# EAGLE board Resistor_Resistor (EAGLE 8.3.0), part 26 of 32
## Placement (x,y rotation side) (continued)
R31697  10K  [0201]  217.98,59.79 0 top
R31698  10K  [0201]  217.98,60.4 0 top
R31699  10K  [0201]  217.98,61.01 0 top
R31700  10K  [0201]  217.98,61.62 0 top
R31701  10K  [0201]  217.98,62.23 0 top
R31702  10K  [0201]  217.98,62.84 0 top
R31703  10K  [0201]  217.98,63.45 0 top
R31704  10K  [0201]  217.98,64.06 0 top
R31705  10K  [0201]  217.98,64.67 0 top
R31706  10K  [0201]  217.98,65.28 0 top
R31707  10K  [0201]  217.98,65.89 0 top
R31708  10K  [0201]  217.98,66.5 0 top
R31709  10K  [0201]  217.98,67.11 0 top
R31710  10K  [0201]  217.98,67.72 0 top
R31711  10K  [0201]  217.98,68.33 0 top
R31712  10K  [0201]  217.98,68.94 0 top
R31713  10K  [0201]  217.98,69.55 0 top
R31714  10K  [0201]  217.98,70.15 0 top
R31715  10K  [0201]  217.98,70.76 0 top
R31716  10K  [0201]  217.98,71.37 0 top
R31717  10K  [0201]  217.98,71.98 0 top
R31718  10K  [0201]  217.98,72.59 0 top
R31719  10K  [0201]  217.98,73.2 0 top
R31720  10K  [0201]  217.98,73.81 0 top
R31721  10K  [0201]  217.98,74.42 0 top
R31722  10K  [0201]  217.98,75.03 0 top
R31723  10K  [0201]  217.98,75.64 0 top
R31724  10K  [0201]  217.98,76.25 0 top
R31725  10K  [0201]  217.98,76.86 0 top
R31726  10K  [0201]  217.98,77.47 0 top
R31727  10K  [0201]  217.98,78.08 0 top
R31728  10K  [0201]  217.98,78.69 0 top
R31729  10K  [0201]  217.98,79.3 0 top
R31730  10K  [0201]  217.98,79.91 0 top
R31731  10K  [0201]  217.98,80.52 0 top
R31732  10K  [0201]  217.98,81.13 0 top
R31733  10K  [0201]  217.98,81.74 0 top
R31734  10K  [0201]  217.98,82.35 0 top
R31735  10K  [0201]  217.98,82.96 0 top
R31736  10K  [0201]  217.98,83.57 0 top
R31737  10K  [0201]  217.98,84.18 0 top
R31738  10K  [0201]  217.98,84.79 0 top
R31739  10K  [0201]  217.98,85.39 0 top
R31740  10K  [0201]  217.98,86 0 top
R31741  10K  [0201]  217.98,86.61 0 top
R31742  10K  [0201]  217.98,87.22 0 top
R31743  10K  [0201]  217.98,87.83 0 top
R31744  10K  [0201]  217.98,88.44 0 top
R31745  10K  [0201]  217.98,89.05 0 top
R31746  10K  [0201]  217.98,89.66 0 top
R31747  10K  [0201]  217.98,90.27 0 top
R31748  10K  [0201]  217.98,90.88 0 top
R31749  10K  [0201]  217.98,91.49 0 top
R31750  10K  [0201]  217.98,92.1 0 top
R31751  10K  [0201]  217.98,92.71 0 top
R31752  10K  [0201]  217.98,93.32 0 top
R31753  10K  [0201]  217.98,93.93 0 top
R31754  10K  [0201]  217.98,94.54 0 top
R31755  10K  [0201]  217.98,95.15 0 top
R31756  10K  [0201]  217.98,95.76 0 top
R31757  10K  [0201]  217.98,96.37 0 top
R31758  10K  [0201]  217.98,96.98 0 top
R31759  10K  [0201]  217.98,97.59 0 top
R31760  10K  [0201]  217.98,98.2 0 top
R31761  10K  [0201]  217.98,98.81 0 top
R31762  10K  [0201]  217.98,99.42 0 top
R31763  10K  [0201]  217.98,100.03 0 top
R31764  10K  [0201]  217.98,100.63 0 top
R31765  10K  [0201]  217.98,101.24 0 top
R31766  10K  [0201]  217.98,101.85 0 top
R31767  10K  [0201]  217.98,102.46 0 top
R31768  10K  [0201]  217.98,103.07 0 top
R31769  10K  [0201]  217.98,103.68 0 top
R31770  10K  [0201]  217.98,104.29 0 top
R31771  10K  [0201]  217.98,104.9 0 top
R31772  10K  [0201]  217.98,105.51 0 top
R31773  10K  [0201]  217.98,106.12 0 top
R31774  10K  [0201]  217.98,106.73 0 top
R31775  10K  [0201]  217.98,107.34 0 top
R31776  10K  [0201]  217.98,107.95 0 top
R31777  10K  [0201]  217.98,108.56 0 top
R31778  10K  [0201]  217.98,109.17 0 top
R31779  10K  [0201]  217.98,109.78 0 top
R31780  10K  [0201]  217.98,110.39 0 top
R31781  10K  [0201]  217.98,111 0 top
R31782  10K  [0201]  217.98,111.61 0 top
R31783  10K  [0201]  217.98,112.22 0 top
R31784  10K  [0201]  217.98,112.83 0 top
R31785  10K  [0201]  217.98,113.44 0 top
R31786  10K  [0201]  217.98,114.05 0 top
R31787  10K  [0201]  217.98,114.66 0 top
R31788  10K  [0201]  217.98,115.27 0 top
R31789  10K  [0201]  217.98,115.87 0 top
R31790  10K  [0201]  217.98,116.48 0 top
R31791  10K  [0201]  217.98,117.09 0 top
R31792  10K  [0201]  217.98,117.7 0 top
R31793  10K  [0201]  217.98,118.31 0 top
R31794  10K  [0201]  217.98,118.92 0 top
R31795  10K  [0201]  217.98,119.53 0 top
R31796  10K  [0201]  217.98,120.14 0 top
R31797  10K  [0201]  217.98,120.75 0 top
R31798  10K  [0201]  217.98,121.36 0 top
R31799  10K  [0201]  217.98,121.97 0 top
R31800  10K  [0201]  217.98,122.58 0 top
R31801  10K  [0201]  219.2,1.27 0 top
R31802  10K  [0201]  219.2,1.88 0 top
R31803  10K  [0201]  219.2,2.49 0 top
R31804  10K  [0201]  219.2,3.1 0 top
R31805  10K  [0201]  219.2,3.71 0 top
R31806  10K  [0201]  219.2,4.32 0 top
R31807  10K  [0201]  219.2,4.93 0 top
R31808  10K  [0201]  219.2,5.54 0 top
R31809  10K  [0201]  219.2,6.15 0 top
R31810  10K  [0201]  219.2,6.76 0 top
R31811  10K  [0201]  219.2,7.37 0 top
R31812  10K  [0201]  219.2,7.98 0 top
R31813  10K  [0201]  219.2,8.59 0 top
R31814  10K  [0201]  219.2,9.19 0 top
R31815  10K  [0201]  219.2,9.8 0 top
R31816  10K  [0201]  219.2,10.41 0 top
R31817  10K  [0201]  219.2,11.02 0 top
R31818  10K  [0201]  219.2,11.63 0 top
R31819  10K  [0201]  219.2,12.24 0 top
R31820  10K  [0201]  219.2,12.85 0 top
R31821  10K  [0201]  219.2,13.46 0 top
R31822  10K  [0201]  219.2,14.07 0 top
R31823  10K  [0201]  219.2,14.68 0 top
R31824  10K  [0201]  219.2,15.29 0 top
R31825  10K  [0201]  219.2,15.9 0 top
R31826  10K  [0201]  219.2,16.51 0 top
R31827  10K  [0201]  219.2,17.12 0 top
R31828  10K  [0201]  219.2,17.73 0 top
R31829  10K  [0201]  219.2,18.34 0 top
R31830  10K  [0201]  219.2,18.95 0 top
R31831  10K  [0201]  219.2,19.56 0 top
R31832  10K  [0201]  219.2,20.17 0 top
R31833  10K  [0201]  219.2,20.78 0 top
R31834  10K  [0201]  219.2,21.39 0 top
R31835  10K  [0201]  219.2,22 0 top
R31836  10K  [0201]  219.2,22.61 0 top
R31837  10K  [0201]  219.2,23.22 0 top
R31838  10K  [0201]  219.2,23.83 0 top
R31839  10K  [0201]  219.2,24.43 0 top
R31840  10K  [0201]  219.2,25.04 0 top
R31841  10K  [0201]  219.2,25.65 0 top
R31842  10K  [0201]  219.2,26.26 0 top
R31843  10K  [0201]  219.2,26.87 0 top
R31844  10K  [0201]  219.2,27.48 0 top
R31845  10K  [0201]  219.2,28.09 0 top
R31846  10K  [0201]  219.2,28.7 0 top
R31847  10K  [0201]  219.2,29.31 0 top
R31848  10K  [0201]  219.2,29.92 0 top
R31849  10K  [0201]  219.2,30.53 0 top
R31850  10K  [0201]  219.2,31.14 0 top
R31851  10K  [0201]  219.2,31.75 0 top
R31852  10K  [0201]  219.2,32.36 0 top
R31853  10K  [0201]  219.2,32.97 0 top
R31854  10K  [0201]  219.2,33.58 0 top
R31855  10K  [0201]  219.2,34.19 0 top
R31856  10K  [0201]  219.2,34.8 0 top
R31857  10K  [0201]  219.2,35.41 0 top
R31858  10K  [0201]  219.2,36.02 0 top
R31859  10K  [0201]  219.2,36.63 0 top
R31860  10K  [0201]  219.2,37.24 0 top
R31861  10K  [0201]  219.2,37.85 0 top
R31862  10K  [0201]  219.2,38.46 0 top
R31863  10K  [0201]  219.2,39.07 0 top
R31864  10K  [0201]  219.2,39.67 0 top
R31865  10K  [0201]  219.2,40.28 0 top
R31866  10K  [0201]  219.2,40.89 0 top
R31867  10K  [0201]  219.2,41.5 0 top
R31868  10K  [0201]  219.2,42.11 0 top
R31869  10K  [0201]  219.2,42.72 0 top
R31870  10K  [0201]  219.2,43.33 0 top
R31871  10K  [0201]  219.2,43.94 0 top
R31872  10K  [0201]  219.2,44.55 0 top
R31873  10K  [0201]  219.2,45.16 0 top
R31874  10K  [0201]  219.2,45.77 0 top
R31875  10K  [0201]  219.2,46.38 0 top
R31876  10K  [0201]  219.2,46.99 0 top
R31877  10K  [0201]  219.2,47.6 0 top
R31878  10K  [0201]  219.2,48.21 0 top
R31879  10K  [0201]  219.2,48.82 0 top
R31880  10K  [0201]  219.2,49.43 0 top
R31881  10K  [0201]  219.2,50.04 0 top
R31882  10K  [0201]  219.2,50.65 0 top
R31883  10K  [0201]  219.2,51.26 0 top
R31884  10K  [0201]  219.2,51.87 0 top
R31885  10K  [0201]  219.2,52.48 0 top
R31886  10K  [0201]  219.2,53.09 0 top
R31887  10K  [0201]  219.2,53.7 0 top
R31888  10K  [0201]  219.2,54.31 0 top
R31889  10K  [0201]  219.2,54.91 0 top
R31890  10K  [0201]  219.2,55.52 0 top
R31891  10K  [0201]  219.2,56.13 0 top
R31892  10K  [0201]  219.2,56.74 0 top
R31893  10K  [0201]  219.2,57.35 0 top
R31894  10K  [0201]  219.2,57.96 0 top
R31895  10K  [0201]  219.2,58.57 0 top
R31896  10K  [0201]  219.2,59.18 0 top
R31897  10K  [0201]  219.2,59.79 0 top
R31898  10K  [0201]  219.2,60.4 0 top
R31899  10K  [0201]  219.2,61.01 0 top
R31900  10K  [0201]  219.2,61.62 0 top
R31901  10K  [0201]  219.2,62.23 0 top
R31902  10K  [0201]  219.2,62.84 0 top
R31903  10K  [0201]  219.2,63.45 0 top
R31904  10K  [0201]  219.2,64.06 0 top
R31905  10K  [0201]  219.2,64.67 0 top
R31906  10K  [0201]  219.2,65.28 0 top
R31907  10K  [0201]  219.2,65.89 0 top
R31908  10K  [0201]  219.2,66.5 0 top
R31909  10K  [0201]  219.2,67.11 0 top
R31910  10K  [0201]  219.2,67.72 0 top
R31911  10K  [0201]  219.2,68.33 0 top
R31912  10K  [0201]  219.2,68.94 0 top
R31913  10K  [0201]  219.2,69.55 0 top
R31914  10K  [0201]  219.2,70.15 0 top
R31915  10K  [0201]  219.2,70.76 0 top
R31916  10K  [0201]  219.2,71.37 0 top
R31917  10K  [0201]  219.2,71.98 0 top
R31918  10K  [0201]  219.2,72.59 0 top
R31919  10K  [0201]  219.2,73.2 0 top
R31920  10K  [0201]  219.2,73.81 0 top
R31921  10K  [0201]  219.2,74.42 0 top
R31922  10K  [0201]  219.2,75.03 0 top
R31923  10K  [0201]  219.2,75.64 0 top
R31924  10K  [0201]  219.2,76.25 0 top
R31925  10K  [0201]  219.2,76.86 0 top
R31926  10K  [0201]  219.2,77.47 0 top
R31927  10K  [0201]  219.2,78.08 0 top
R31928  10K  [0201]  219.2,78.69 0 top
R31929  10K  [0201]  219.2,79.3 0 top
R31930  10K  [0201]  219.2,79.91 0 top
R31931  10K  [0201]  219.2,80.52 0 top
R31932  10K  [0201]  219.2,81.13 0 top
R31933  10K  [0201]  219.2,81.74 0 top
R31934  10K  [0201]  219.2,82.35 0 top
R31935  10K  [0201]  219.2,82.96 0 top
R31936  10K  [0201]  219.2,83.57 0 top
R31937  10K  [0201]  219.2,84.18 0 top
R31938  10K  [0201]  219.2,84.79 0 top
R31939  10K  [0201]  219.2,85.39 0 top
R31940  10K  [0201]  219.2,86 0 top
R31941  10K  [0201]  219.2,86.61 0 top
R31942  10K  [0201]  219.2,87.22 0 top
R31943  10K  [0201]  219.2,87.83 0 top
R31944  10K  [0201]  219.2,88.44 0 top
R31945  10K  [0201]  219.2,89.05 0 top
R31946  10K  [0201]  219.2,89.66 0 top
R31947  10K  [0201]  219.2,90.27 0 top
R31948  10K  [0201]  219.2,90.88 0 top
R31949  10K  [0201]  219.2,91.49 0 top
R31950  10K  [0201]  219.2,92.1 0 top
R31951  10K  [0201]  219.2,92.71 0 top
R31952  10K  [0201]  219.2,93.32 0 top
R31953  10K  [0201]  219.2,93.93 0 top
R31954  10K  [0201]  219.2,94.54 0 top
R31955  10K  [0201]  219.2,95.15 0 top
R31956  10K  [0201]  219.2,95.76 0 top
R31957  10K  [0201]  219.2,96.37 0 top
R31958  10K  [0201]  219.2,96.98 0 top
R31959  10K  [0201]  219.2,97.59 0 top
R31960  10K  [0201]  219.2,98.2 0 top
R31961  10K  [0201]  219.2,98.81 0 top
R31962  10K  [0201]  219.2,99.42 0 top
R31963  10K  [0201]  219.2,100.03 0 top
R31964  10K  [0201]  219.2,100.63 0 top
R31965  10K  [0201]  219.2,101.24 0 top
R31966  10K  [0201]  219.2,101.85 0 top
R31967  10K  [0201]  219.2,102.46 0 top
R31968  10K  [0201]  219.2,103.07 0 top
R31969  10K  [0201]  219.2,103.68 0 top
R31970  10K  [0201]  219.2,104.29 0 top
R31971  10K  [0201]  219.2,104.9 0 top
R31972  10K  [0201]  219.2,105.51 0 top
R31973  10K  [0201]  219.2,106.12 0 top
R31974  10K  [0201]  219.2,106.73 0 top
R31975  10K  [0201]  219.2,107.34 0 top
R31976  10K  [0201]  219.2,107.95 0 top
R31977  10K  [0201]  219.2,108.56 0 top
R31978  10K  [0201]  219.2,109.17 0 top
R31979  10K  [0201]  219.2,109.78 0 top
R31980  10K  [0201]  219.2,110.39 0 top
R31981  10K  [0201]  219.2,111 0 top
R31982  10K  [0201]  219.2,111.61 0 top
R31983  10K  [0201]  219.2,112.22 0 top
R31984  10K  [0201]  219.2,112.83 0 top
R31985  10K  [0201]  219.2,113.44 0 top
R31986  10K  [0201]  219.2,114.05 0 top
R31987  10K  [0201]  219.2,114.66 0 top
R31988  10K  [0201]  219.2,115.27 0 top
R31989  10K  [0201]  219.2,115.87 0 top
R31990  10K  [0201]  219.2,116.48 0 top
R31991  10K  [0201]  219.2,117.09 0 top
R31992  10K  [0201]  219.2,117.7 0 top
R31993  10K  [0201]  219.2,118.31 0 top
R31994  10K  [0201]  219.2,118.92 0 top
R31995  10K  [0201]  219.2,119.53 0 top
R31996  10K  [0201]  219.2,120.14 0 top
R31997  10K  [0201]  219.2,120.75 0 top
R31998  10K  [0201]  219.2,121.36 0 top
R31999  10K  [0201]  219.2,121.97 0 top
R32000  10K  [0201]  219.2,122.58 0 top
R32001  10K  [0201]  220.42,1.27 0 top
R32002  10K  [0201]  220.42,1.88 0 top
R32003  10K  [0201]  220.42,2.49 0 top
R32004  10K  [0201]  220.42,3.1 0 top
R32005  10K  [0201]  220.42,3.71 0 top
R32006  10K  [0201]  220.42,4.32 0 top
R32007  10K  [0201]  220.42,4.93 0 top
R32008  10K  [0201]  220.42,5.54 0 top
R32009  10K  [0201]  220.42,6.15 0 top
R32010  10K  [0201]  220.42,6.76 0 top
R32011  10K  [0201]  220.42,7.37 0 top
R32012  10K  [0201]  220.42,7.98 0 top
R32013  10K  [0201]  220.42,8.59 0 top
R32014  10K  [0201]  220.42,9.19 0 top
R32015  10K  [0201]  220.42,9.8 0 top
R32016  10K  [0201]  220.42,10.41 0 top
R32017  10K  [0201]  220.42,11.02 0 top
R32018  10K  [0201]  220.42,11.63 0 top
R32019  10K  [0201]  220.42,12.24 0 top
R32020  10K  [0201]  220.42,12.85 0 top
R32021  10K  [0201]  220.42,13.46 0 top
R32022  10K  [0201]  220.42,14.07 0 top
R32023  10K  [0201]  220.42,14.68 0 top
R32024  10K  [0201]  220.42,15.29 0 top
R32025  10K  [0201]  220.42,15.9 0 top
R32026  10K  [0201]  220.42,16.51 0 top
R32027  10K  [0201]  220.42,17.12 0 top
R32028  10K  [0201]  220.42,17.73 0 top
R32029  10K  [0201]  220.42,18.34 0 top
R32030  10K  [0201]  220.42,18.95 0 top
R32031  10K  [0201]  220.42,19.56 0 top
R32032  10K  [0201]  220.42,20.17 0 top
R32033  10K  [0201]  220.42,20.78 0 top
R32034  10K  [0201]  220.42,21.39 0 top
R32035  10K  [0201]  220.42,22 0 top
R32036  10K  [0201]  220.42,22.61 0 top
R32037  10K  [0201]  220.42,23.22 0 top
R32038  10K  [0201]  220.42,23.83 0 top
R32039  10K  [0201]  220.42,24.43 0 top
R32040  10K  [0201]  220.42,25.04 0 top
R32041  10K  [0201]  220.42,25.65 0 top
R32042  10K  [0201]  220.42,26.26 0 top
R32043  10K  [0201]  220.42,26.87 0 top
R32044  10K  [0201]  220.42,27.48 0 top
R32045  10K  [0201]  220.42,28.09 0 top
R32046  10K  [0201]  220.42,28.7 0 top
R32047  10K  [0201]  220.42,29.31 0 top
R32048  10K  [0201]  220.42,29.92 0 top
R32049  10K  [0201]  220.42,30.53 0 top
R32050  10K  [0201]  220.42,31.14 0 top
R32051  10K  [0201]  220.42,31.75 0 top
R32052  10K  [0201]  220.42,32.36 0 top
R32053  10K  [0201]  220.42,32.97 0 top
R32054  10K  [0201]  220.42,33.58 0 top
R32055  10K  [0201]  220.42,34.19 0 top
R32056  10K  [0201]  220.42,34.8 0 top
R32057  10K  [0201]  220.42,35.41 0 top
R32058  10K  [0201]  220.42,36.02 0 top
R32059  10K  [0201]  220.42,36.63 0 top
R32060  10K  [0201]  220.42,37.24 0 top
R32061  10K  [0201]  220.42,37.85 0 top
R32062  10K  [0201]  220.42,38.46 0 top
R32063  10K  [0201]  220.42,39.07 0 top
R32064  10K  [0201]  220.42,39.67 0 top
R32065  10K  [0201]  220.42,40.28 0 top
R32066  10K  [0201]  220.42,40.89 0 top
R32067  10K  [0201]  220.42,41.5 0 top
R32068  10K  [0201]  220.42,42.11 0 top
R32069  10K  [0201]  220.42,42.72 0 top
R32070  10K  [0201]  220.42,43.33 0 top
R32071  10K  [0201]  220.42,43.94 0 top
R32072  10K  [0201]  220.42,44.55 0 top
R32073  10K  [0201]  220.42,45.16 0 top
R32074  10K  [0201]  220.42,45.77 0 top
R32075  10K  [0201]  220.42,46.38 0 top
R32076  10K  [0201]  220.42,46.99 0 top
R32077  10K  [0201]  220.42,47.6 0 top
R32078  10K  [0201]  220.42,48.21 0 top
R32079  10K  [0201]  220.42,48.82 0 top
R32080  10K  [0201]  220.42,49.43 0 top
R32081  10K  [0201]  220.42,50.04 0 top
R32082  10K  [0201]  220.42,50.65 0 top
R32083  10K  [0201]  220.42,51.26 0 top
R32084  10K  [0201]  220.42,51.87 0 top
R32085  10K  [0201]  220.42,52.48 0 top
R32086  10K  [0201]  220.42,53.09 0 top
R32087  10K  [0201]  220.42,53.7 0 top
R32088  10K  [0201]  220.42,54.31 0 top
R32089  10K  [0201]  220.42,54.91 0 top
R32090  10K  [0201]  220.42,55.52 0 top
R32091  10K  [0201]  220.42,56.13 0 top
R32092  10K  [0201]  220.42,56.74 0 top
R32093  10K  [0201]  220.42,57.35 0 top
R32094  10K  [0201]  220.42,57.96 0 top
R32095  10K  [0201]  220.42,58.57 0 top
R32096  10K  [0201]  220.42,59.18 0 top
R32097  10K  [0201]  220.42,59.79 0 top
R32098  10K  [0201]  220.42,60.4 0 top
R32099  10K  [0201]  220.42,61.01 0 top
R32100  10K  [0201]  220.42,61.62 0 top
R32101  10K  [0201]  220.42,62.23 0 top
R32102  10K  [0201]  220.42,62.84 0 top
R32103  10K  [0201]  220.42,63.45 0 top
R32104  10K  [0201]  220.42,64.06 0 top
R32105  10K  [0201]  220.42,64.67 0 top
R32106  10K  [0201]  220.42,65.28 0 top
R32107  10K  [0201]  220.42,65.89 0 top
R32108  10K  [0201]  220.42,66.5 0 top
R32109  10K  [0201]  220.42,67.11 0 top
R32110  10K  [0201]  220.42,67.72 0 top
R32111  10K  [0201]  220.42,68.33 0 top
R32112  10K  [0201]  220.42,68.94 0 top
R32113  10K  [0201]  220.42,69.55 0 top
R32114  10K  [0201]  220.42,70.15 0 top
R32115  10K  [0201]  220.42,70.76 0 top
R32116  10K  [0201]  220.42,71.37 0 top
R32117  10K  [0201]  220.42,71.98 0 top
R32118  10K  [0201]  220.42,72.59 0 top
R32119  10K  [0201]  220.42,73.2 0 top
R32120  10K  [0201]  220.42,73.81 0 top
R32121  10K  [0201]  220.42,74.42 0 top
R32122  10K  [0201]  220.42,75.03 0 top
R32123  10K  [0201]  220.42,75.64 0 top
R32124  10K  [0201]  220.42,76.25 0 top
R32125  10K  [0201]  220.42,76.86 0 top
R32126  10K  [0201]  220.42,77.47 0 top
R32127  10K  [0201]  220.42,78.08 0 top
R32128  10K  [0201]  220.42,78.69 0 top
R32129  10K  [0201]  220.42,79.3 0 top
R32130  10K  [0201]  220.42,79.91 0 top
R32131  10K  [0201]  220.42,80.52 0 top
R32132  10K  [0201]  220.42,81.13 0 top
R32133  10K  [0201]  220.42,81.74 0 top
R32134  10K  [0201]  220.42,82.35 0 top
R32135  10K  [0201]  220.42,82.96 0 top
R32136  10K  [0201]  220.42,83.57 0 top
R32137  10K  [0201]  220.42,84.18 0 top
R32138  10K  [0201]  220.42,84.79 0 top
R32139  10K  [0201]  220.42,85.39 0 top
R32140  10K  [0201]  220.42,86 0 top
R32141  10K  [0201]  220.42,86.61 0 top
R32142  10K  [0201]  220.42,87.22 0 top
R32143  10K  [0201]  220.42,87.83 0 top
R32144  10K  [0201]  220.42,88.44 0 top
R32145  10K  [0201]  220.42,89.05 0 top
R32146  10K  [0201]  220.42,89.66 0 top
R32147  10K  [0201]  220.42,90.27 0 top
R32148  10K  [0201]  220.42,90.88 0 top
R32149  10K  [0201]  220.42,91.49 0 top
R32150  10K  [0201]  220.42,92.1 0 top
R32151  10K  [0201]  220.42,92.71 0 top
R32152  10K  [0201]  220.42,93.32 0 top
R32153  10K  [0201]  220.42,93.93 0 top
R32154  10K  [0201]  220.42,94.54 0 top
R32155  10K  [0201]  220.42,95.15 0 top
R32156  10K  [0201]  220.42,95.76 0 top
R32157  10K  [0201]  220.42,96.37 0 top
R32158  10K  [0201]  220.42,96.98 0 top
R32159  10K  [0201]  220.42,97.59 0 top
R32160  10K  [0201]  220.42,98.2 0 top
R32161  10K  [0201]  220.42,98.81 0 top
R32162  10K  [0201]  220.42,99.42 0 top
R32163  10K  [0201]  220.42,100.03 0 top
R32164  10K  [0201]  220.42,100.63 0 top
R32165  10K  [0201]  220.42,101.24 0 top
R32166  10K  [0201]  220.42,101.85 0 top
R32167  10K  [0201]  220.42,102.46 0 top
R32168  10K  [0201]  220.42,103.07 0 top
R32169  10K  [0201]  220.42,103.68 0 top
R32170  10K  [0201]  220.42,104.29 0 top
R32171  10K  [0201]  220.42,104.9 0 top
R32172  10K  [0201]  220.42,105.51 0 top
R32173  10K  [0201]  220.42,106.12 0 top
R32174  10K  [0201]  220.42,106.73 0 top
R32175  10K  [0201]  220.42,107.34 0 top
R32176  10K  [0201]  220.42,107.95 0 top
R32177  10K  [0201]  220.42,108.56 0 top
R32178  10K  [0201]  220.42,109.17 0 top
R32179  10K  [0201]  220.42,109.78 0 top
R32180  10K  [0201]  220.42,110.39 0 top
R32181  10K  [0201]  220.42,111 0 top
R32182  10K  [0201]  220.42,111.61 0 top
R32183  10K  [0201]  220.42,112.22 0 top
R32184  10K  [0201]  220.42,112.83 0 top
R32185  10K  [0201]  220.42,113.44 0 top
R32186  10K  [0201]  220.42,114.05 0 top
R32187  10K  [0201]  220.42,114.66 0 top
R32188  10K  [0201]  220.42,115.27 0 top
R32189  10K  [0201]  220.42,115.87 0 top
R32190  10K  [0201]  220.42,116.48 0 top
R32191  10K  [0201]  220.42,117.09 0 top
R32192  10K  [0201]  220.42,117.7 0 top
R32193  10K  [0201]  220.42,118.31 0 top
R32194  10K  [0201]  220.42,118.92 0 top
R32195  10K  [0201]  220.42,119.53 0 top
R32196  10K  [0201]  220.42,120.14 0 top
R32197  10K  [0201]  220.42,120.75 0 top
R32198  10K  [0201]  220.42,121.36 0 top
R32199  10K  [0201]  220.42,121.97 0 top
R32200  10K  [0201]  220.42,122.58 0 top
R32201  10K  [0201]  221.64,1.27 0 top
R32202  10K  [0201]  221.64,1.88 0 top
R32203  10K  [0201]  221.64,2.49 0 top
R32204  10K  [0201]  221.64,3.1 0 top
R32205  10K  [0201]  221.64,3.71 0 top
R32206  10K  [0201]  221.64,4.32 0 top
R32207  10K  [0201]  221.64,4.93 0 top
R32208  10K  [0201]  221.64,5.54 0 top
R32209  10K  [0201]  221.64,6.15 0 top
R32210  10K  [0201]  221.64,6.76 0 top
R32211  10K  [0201]  221.64,7.37 0 top
R32212  10K  [0201]  221.64,7.98 0 top
R32213  10K  [0201]  221.64,8.59 0 top
R32214  10K  [0201]  221.64,9.19 0 top
R32215  10K  [0201]  221.64,9.8 0 top
R32216  10K  [0201]  221.64,10.41 0 top
R32217  10K  [0201]  221.64,11.02 0 top
R32218  10K  [0201]  221.64,11.63 0 top
R32219  10K  [0201]  221.64,12.24 0 top
R32220  10K  [0201]  221.64,12.85 0 top
R32221  10K  [0201]  221.64,13.46 0 top
R32222  10K  [0201]  221.64,14.07 0 top
R32223  10K  [0201]  221.64,14.68 0 top
R32224  10K  [0201]  221.64,15.29 0 top
R32225  10K  [0201]  221.64,15.9 0 top
R32226  10K  [0201]  221.64,16.51 0 top
R32227  10K  [0201]  221.64,17.12 0 top
R32228  10K  [0201]  221.64,17.73 0 top
R32229  10K  [0201]  221.64,18.34 0 top
R32230  10K  [0201]  221.64,18.95 0 top
R32231  10K  [0201]  221.64,19.56 0 top
R32232  10K  [0201]  221.64,20.17 0 top
R32233  10K  [0201]  221.64,20.78 0 top
R32234  10K  [0201]  221.64,21.39 0 top
R32235  10K  [0201]  221.64,22 0 top
R32236  10K  [0201]  221.64,22.61 0 top
R32237  10K  [0201]  221.64,23.22 0 top
R32238  10K  [0201]  221.64,23.83 0 top
R32239  10K  [0201]  221.64,24.43 0 top
R32240  10K  [0201]  221.64,25.04 0 top
R32241  10K  [0201]  221.64,25.65 0 top
R32242  10K  [0201]  221.64,26.26 0 top
R32243  10K  [0201]  221.64,26.87 0 top
R32244  10K  [0201]  221.64,27.48 0 top
R32245  10K  [0201]  221.64,28.09 0 top
R32246  10K  [0201]  221.64,28.7 0 top
R32247  10K  [0201]  221.64,29.31 0 top
R32248  10K  [0201]  221.64,29.92 0 top
R32249  10K  [0201]  221.64,30.53 0 top
R32250  10K  [0201]  221.64,31.14 0 top
R32251  10K  [0201]  221.64,31.75 0 top
R32252  10K  [0201]  221.64,32.36 0 top
R32253  10K  [0201]  221.64,32.97 0 top
R32254  10K  [0201]  221.64,33.58 0 top
R32255  10K  [0201]  221.64,34.19 0 top
R32256  10K  [0201]  221.64,34.8 0 top
R32257  10K  [0201]  221.64,35.41 0 top
R32258  10K  [0201]  221.64,36.02 0 top
R32259  10K  [0201]  221.64,36.63 0 top
R32260  10K  [0201]  221.64,37.24 0 top
R32261  10K  [0201]  221.64,37.85 0 top
R32262  10K  [0201]  221.64,38.46 0 top
R32263  10K  [0201]  221.64,39.07 0 top
R32264  10K  [0201]  221.64,39.67 0 top
R32265  10K  [0201]  221.64,40.28 0 top
R32266  10K  [0201]  221.64,40.89 0 top
R32267  10K  [0201]  221.64,41.5 0 top
R32268  10K  [0201]  221.64,42.11 0 top
R32269  10K  [0201]  221.64,42.72 0 top
R32270  10K  [0201]  221.64,43.33 0 top
R32271  10K  [0201]  221.64,43.94 0 top
R32272  10K  [0201]  221.64,44.55 0 top
R32273  10K  [0201]  221.64,45.16 0 top
R32274  10K  [0201]  221.64,45.77 0 top
R32275  10K  [0201]  221.64,46.38 0 top
R32276  10K  [0201]  221.64,46.99 0 top
R32277  10K  [0201]  221.64,47.6 0 top
R32278  10K  [0201]  221.64,48.21 0 top
R32279  10K  [0201]  221.64,48.82 0 top
R32280  10K  [0201]  221.64,49.43 0 top
R32281  10K  [0201]  221.64,50.04 0 top
R32282  10K  [0201]  221.64,50.65 0 top
R32283  10K  [0201]  221.64,51.26 0 top
R32284  10K  [0201]  221.64,51.87 0 top
R32285  10K  [0201]  221.64,52.48 0 top
R32286  10K  [0201]  221.64,53.09 0 top
R32287  10K  [0201]  221.64,53.7 0 top
R32288  10K  [0201]  221.64,54.31 0 top
R32289  10K  [0201]  221.64,54.91 0 top
R32290  10K  [0201]  221.64,55.52 0 top
R32291  10K  [0201]  221.64,56.13 0 top
R32292  10K  [0201]  221.64,56.74 0 top
R32293  10K  [0201]  221.64,57.35 0 top
R32294  10K  [0201]  221.64,57.96 0 top
R32295  10K  [0201]  221.64,58.57 0 top
R32296  10K  [0201]  221.64,59.18 0 top
R32297  10K  [0201]  221.64,59.79 0 top
R32298  10K  [0201]  221.64,60.4 0 top
R32299  10K  [0201]  221.64,61.01 0 top
R32300  10K  [0201]  221.64,61.62 0 top
R32301  10K  [0201]  221.64,62.23 0 top
R32302  10K  [0201]  221.64,62.84 0 top
R32303  10K  [0201]  221.64,63.45 0 top
R32304  10K  [0201]  221.64,64.06 0 top
R32305  10K  [0201]  221.64,64.67 0 top
R32306  10K  [0201]  221.64,65.28 0 top
R32307  10K  [0201]  221.64,65.89 0 top
R32308  10K  [0201]  221.64,66.5 0 top
R32309  10K  [0201]  221.64,67.11 0 top
R32310  10K  [0201]  221.64,67.72 0 top
R32311  10K  [0201]  221.64,68.33 0 top
R32312  10K  [0201]  221.64,68.94 0 top
R32313  10K  [0201]  221.64,69.55 0 top
R32314  10K  [0201]  221.64,70.15 0 top
R32315  10K  [0201]  221.64,70.76 0 top
R32316  10K  [0201]  221.64,71.37 0 top
R32317  10K  [0201]  221.64,71.98 0 top
R32318  10K  [0201]  221.64,72.59 0 top
R32319  10K  [0201]  221.64,73.2 0 top
R32320  10K  [0201]  221.64,73.81 0 top
R32321  10K  [0201]  221.64,74.42 0 top
R32322  10K  [0201]  221.64,75.03 0 top
R32323  10K  [0201]  221.64,75.64 0 top
R32324  10K  [0201]  221.64,76.25 0 top
R32325  10K  [0201]  221.64,76.86 0 top
R32326  10K  [0201]  221.64,77.47 0 top
R32327  10K  [0201]  221.64,78.08 0 top
R32328  10K  [0201]  221.64,78.69 0 top
R32329  10K  [0201]  221.64,79.3 0 top
R32330  10K  [0201]  221.64,79.91 0 top
R32331  10K  [0201]  221.64,80.52 0 top
R32332  10K  [0201]  221.64,81.13 0 top
R32333  10K  [0201]  221.64,81.74 0 top
R32334  10K  [0201]  221.64,82.35 0 top
R32335  10K  [0201]  221.64,82.96 0 top
R32336  10K  [0201]  221.64,83.57 0 top
R32337  10K  [0201]  221.64,84.18 0 top
R32338  10K  [0201]  221.64,84.79 0 top
R32339  10K  [0201]  221.64,85.39 0 top
R32340  10K  [0201]  221.64,86 0 top
R32341  10K  [0201]  221.64,86.61 0 top
R32342  10K  [0201]  221.64,87.22 0 top
R32343  10K  [0201]  221.64,87.83 0 top
R32344  10K  [0201]  221.64,88.44 0 top
R32345  10K  [0201]  221.64,89.05 0 top
R32346  10K  [0201]  221.64,89.66 0 top
R32347  10K  [0201]  221.64,90.27 0 top
R32348  10K  [0201]  221.64,90.88 0 top
R32349  10K  [0201]  221.64,91.49 0 top
R32350  10K  [0201]  221.64,92.1 0 top
R32351  10K  [0201]  221.64,92.71 0 top
R32352  10K  [0201]  221.64,93.32 0 top
R32353  10K  [0201]  221.64,93.93 0 top
R32354  10K  [0201]  221.64,94.54 0 top
R32355  10K  [0201]  221.64,95.15 0 top
R32356  10K  [0201]  221.64,95.76 0 top
R32357  10K  [0201]  221.64,96.37 0 top
R32358  10K  [0201]  221.64,96.98 0 top
R32359  10K  [0201]  221.64,97.59 0 top
R32360  10K  [0201]  221.64,98.2 0 top
R32361  10K  [0201]  221.64,98.81 0 top
R32362  10K  [0201]  221.64,99.42 0 top
R32363  10K  [0201]  221.64,100.03 0 top
R32364  10K  [0201]  221.64,100.63 0 top
R32365  10K  [0201]  221.64,101.24 0 top
R32366  10K  [0201]  221.64,101.85 0 top
R32367  10K  [0201]  221.64,102.46 0 top
R32368  10K  [0201]  221.64,103.07 0 top
R32369  10K  [0201]  221.64,103.68 0 top
R32370  10K  [0201]  221.64,104.29 0 top
R32371  10K  [0201]  221.64,104.9 0 top
R32372  10K  [0201]  221.64,105.51 0 top
R32373  10K  [0201]  221.64,106.12 0 top
R32374  10K  [0201]  221.64,106.73 0 top
R32375  10K  [0201]  221.64,107.34 0 top
R32376  10K  [0201]  221.64,107.95 0 top
R32377  10K  [0201]  221.64,108.56 0 top
R32378  10K  [0201]  221.64,109.17 0 top
R32379  10K  [0201]  221.64,109.78 0 top
R32380  10K  [0201]  221.64,110.39 0 top
R32381  10K  [0201]  221.64,111 0 top
R32382  10K  [0201]  221.64,111.61 0 top
R32383  10K  [0201]  221.64,112.22 0 top
R32384  10K  [0201]  221.64,112.83 0 top
R32385  10K  [0201]  221.64,113.44 0 top
R32386  10K  [0201]  221.64,114.05 0 top
R32387  10K  [0201]  221.64,114.66 0 top
R32388  10K  [0201]  221.64,115.27 0 top
R32389  10K  [0201]  221.64,115.87 0 top
R32390  10K  [0201]  221.64,116.48 0 top
R32391  10K  [0201]  221.64,117.09 0 top
R32392  10K  [0201]  221.64,117.7 0 top
R32393  10K  [0201]  221.64,118.31 0 top
R32394  10K  [0201]  221.64,118.92 0 top
R32395  10K  [0201]  221.64,119.53 0 top
R32396  10K  [0201]  221.64,120.14 0 top
R32397  10K  [0201]  221.64,120.75 0 top
R32398  10K  [0201]  221.64,121.36 0 top
R32399  10K  [0201]  221.64,121.97 0 top
R32400  10K  [0201]  221.64,122.58 0 top
R32401  10K  [0201]  222.86,1.27 0 top
R32402  10K  [0201]  222.86,1.88 0 top
R32403  10K  [0201]  222.86,2.49 0 top
R32404  10K  [0201]  222.86,3.1 0 top
R32405  10K  [0201]  222.86,3.71 0 top
R32406  10K  [0201]  222.86,4.32 0 top
R32407  10K  [0201]  222.86,4.93 0 top
R32408  10K  [0201]  222.86,5.54 0 top
R32409  10K  [0201]  222.86,6.15 0 top
R32410  10K  [0201]  222.86,6.76 0 top
R32411  10K  [0201]  222.86,7.37 0 top
R32412  10K  [0201]  222.86,7.98 0 top
R32413  10K  [0201]  222.86,8.59 0 top
R32414  10K  [0201]  222.86,9.19 0 top
R32415  10K  [0201]  222.86,9.8 0 top
R32416  10K  [0201]  222.86,10.41 0 top
R32417  10K  [0201]  222.86,11.02 0 top
R32418  10K  [0201]  222.86,11.63 0 top
R32419  10K  [0201]  222.86,12.24 0 top
R32420  10K  [0201]  222.86,12.85 0 top
R32421  10K  [0201]  222.86,13.46 0 top
R32422  10K  [0201]  222.86,14.07 0 top
R32423  10K  [0201]  222.86,14.68 0 top
R32424  10K  [0201]  222.86,15.29 0 top
R32425  10K  [0201]  222.86,15.9 0 top
R32426  10K  [0201]  222.86,16.51 0 top
R32427  10K  [0201]  222.86,17.12 0 top
R32428  10K  [0201]  222.86,17.73 0 top
R32429  10K  [0201]  222.86,18.34 0 top
R32430  10K  [0201]  222.86,18.95 0 top
R32431  10K  [0201]  222.86,19.56 0 top
R32432  10K  [0201]  222.86,20.17 0 top
R32433  10K  [0201]  222.86,20.78 0 top
R32434  10K  [0201]  222.86,21.39 0 top
R32435  10K  [0201]  222.86,22 0 top
R32436  10K  [0201]  222.86,22.61 0 top
R32437  10K  [0201]  222.86,23.22 0 top
R32438  10K  [0201]  222.86,23.83 0 top
R32439  10K  [0201]  222.86,24.43 0 top
R32440  10K  [0201]  222.86,25.04 0 top
R32441  10K  [0201]  222.86,25.65 0 top
R32442  10K  [0201]  222.86,26.26 0 top
R32443  10K  [0201]  222.86,26.87 0 top
R32444  10K  [0201]  222.86,27.48 0 top
R32445  10K  [0201]  222.86,28.09 0 top
R32446  10K  [0201]  222.86,28.7 0 top
R32447  10K  [0201]  222.86,29.31 0 top
R32448  10K  [0201]  222.86,29.92 0 top
R32449  10K  [0201]  222.86,30.53 0 top
R32450  10K  [0201]  222.86,31.14 0 top
R32451  10K  [0201]  222.86,31.75 0 top
R32452  10K  [0201]  222.86,32.36 0 top
R32453  10K  [0201]  222.86,32.97 0 top
R32454  10K  [0201]  222.86,33.58 0 top
R32455  10K  [0201]  222.86,34.19 0 top
R32456  10K  [0201]  222.86,34.8 0 top
R32457  10K  [0201]  222.86,35.41 0 top
R32458  10K  [0201]  222.86,36.02 0 top
R32459  10K  [0201]  222.86,36.63 0 top
R32460  10K  [0201]  222.86,37.24 0 top
R32461  10K  [0201]  222.86,37.85 0 top
R32462  10K  [0201]  222.86,38.46 0 top
R32463  10K  [0201]  222.86,39.07 0 top
R32464  10K  [0201]  222.86,39.67 0 top
R32465  10K  [0201]  222.86,40.28 0 top
R32466  10K  [0201]  222.86,40.89 0 top
R32467  10K  [0201]  222.86,41.5 0 top
R32468  10K  [0201]  222.86,42.11 0 top
R32469  10K  [0201]  222.86,42.72 0 top
R32470  10K  [0201]  222.86,43.33 0 top
R32471  10K  [0201]  222.86,43.94 0 top
R32472  10K  [0201]  222.86,44.55 0 top
R32473  10K  [0201]  222.86,45.16 0 top
R32474  10K  [0201]  222.86,45.77 0 top
R32475  10K  [0201]  222.86,46.38 0 top
R32476  10K  [0201]  222.86,46.99 0 top
R32477  10K  [0201]  222.86,47.6 0 top
R32478  10K  [0201]  222.86,48.21 0 top
R32479  10K  [0201]  222.86,48.82 0 top
R32480  10K  [0201]  222.86,49.43 0 top
R32481  10K  [0201]  222.86,50.04 0 top
R32482  10K  [0201]  222.86,50.65 0 top
R32483  10K  [0201]  222.86,51.26 0 top
R32484  10K  [0201]  222.86,51.87 0 top
R32485  10K  [0201]  222.86,52.48 0 top
R32486  10K  [0201]  222.86,53.09 0 top
R32487  10K  [0201]  222.86,53.7 0 top
R32488  10K  [0201]  222.86,54.31 0 top
R32489  10K  [0201]  222.86,54.91 0 top
R32490  10K  [0201]  222.86,55.52 0 top
R32491  10K  [0201]  222.86,56.13 0 top
R32492  10K  [0201]  222.86,56.74 0 top
R32493  10K  [0201]  222.86,57.35 0 top
R32494  10K  [0201]  222.86,57.96 0 top
R32495  10K  [0201]  222.86,58.57 0 top
R32496  10K  [0201]  222.86,59.18 0 top
R32497  10K  [0201]  222.86,59.79 0 top
R32498  10K  [0201]  222.86,60.4 0 top
R32499  10K  [0201]  222.86,61.01 0 top
R32500  10K  [0201]  222.86,61.62 0 top
R32501  10K  [0201]  222.86,62.23 0 top
R32502  10K  [0201]  222.86,62.84 0 top
R32503  10K  [0201]  222.86,63.45 0 top
R32504  10K  [0201]  222.86,64.06 0 top
R32505  10K  [0201]  222.86,64.67 0 top
R32506  10K  [0201]  222.86,65.28 0 top
R32507  10K  [0201]  222.86,65.89 0 top
R32508  10K  [0201]  222.86,66.5 0 top
R32509  10K  [0201]  222.86,67.11 0 top
R32510  10K  [0201]  222.86,67.72 0 top
R32511  10K  [0201]  222.86,68.33 0 top
R32512  10K  [0201]  222.86,68.94 0 top
R32513  10K  [0201]  222.86,69.55 0 top
R32514  10K  [0201]  222.86,70.15 0 top
R32515  10K  [0201]  222.86,70.76 0 top
R32516  10K  [0201]  222.86,71.37 0 top
R32517  10K  [0201]  222.86,71.98 0 top
R32518  10K  [0201]  222.86,72.59 0 top
R32519  10K  [0201]  222.86,73.2 0 top
R32520  10K  [0201]  222.86,73.81 0 top
R32521  10K  [0201]  222.86,74.42 0 top
R32522  10K  [0201]  222.86,75.03 0 top
R32523  10K  [0201]  222.86,75.64 0 top
R32524  10K  [0201]  222.86,76.25 0 top
R32525  10K  [0201]  222.86,76.86 0 top
R32526  10K  [0201]  222.86,77.47 0 top
R32527  10K  [0201]  222.86,78.08 0 top
R32528  10K  [0201]  222.86,78.69 0 top
R32529  10K  [0201]  222.86,79.3 0 top
R32530  10K  [0201]  222.86,79.91 0 top
R32531  10K  [0201]  222.86,80.52 0 top
R32532  10K  [0201]  222.86,81.13 0 top
R32533  10K  [0201]  222.86,81.74 0 top
R32534  10K  [0201]  222.86,82.35 0 top
R32535  10K  [0201]  222.86,82.96 0 top
R32536  10K  [0201]  222.86,83.57 0 top
R32537  10K  [0201]  222.86,84.18 0 top
R32538  10K  [0201]  222.86,84.79 0 top
R32539  10K  [0201]  222.86,85.39 0 top
R32540  10K  [0201]  222.86,86 0 top
R32541  10K  [0201]  222.86,86.61 0 top
R32542  10K  [0201]  222.86,87.22 0 top
R32543  10K  [0201]  222.86,87.83 0 top
R32544  10K  [0201]  222.86,88.44 0 top
R32545  10K  [0201]  222.86,89.05 0 top
R32546  10K  [0201]  222.86,89.66 0 top
R32547  10K  [0201]  222.86,90.27 0 top
R32548  10K  [0201]  222.86,90.88 0 top
R32549  10K  [0201]  222.86,91.49 0 top
R32550  10K  [0201]  222.86,92.1 0 top
R32551  10K  [0201]  222.86,92.71 0 top
R32552  10K  [0201]  222.86,93.32 0 top
R32553  10K  [0201]  222.86,93.93 0 top
R32554  10K  [0201]  222.86,94.54 0 top
R32555  10K  [0201]  222.86,95.15 0 top
R32556  10K  [0201]  222.86,95.76 0 top
R32557  10K  [0201]  222.86,96.37 0 top
R32558  10K  [0201]  222.86,96.98 0 top
R32559  10K  [0201]  222.86,97.59 0 top
R32560  10K  [0201]  222.86,98.2 0 top
R32561  10K  [0201]  222.86,98.81 0 top
R32562  10K  [0201]  222.86,99.42 0 top
R32563  10K  [0201]  222.86,100.03 0 top
R32564  10K  [0201]  222.86,100.63 0 top
R32565  10K  [0201]  222.86,101.24 0 top
R32566  10K  [0201]  222.86,101.85 0 top
R32567  10K  [0201]  222.86,102.46 0 top
R32568  10K  [0201]  222.86,103.07 0 top
R32569  10K  [0201]  222.86,103.68 0 top
R32570  10K  [0201]  222.86,104.29 0 top
R32571  10K  [0201]  222.86,104.9 0 top
R32572  10K  [0201]  222.86,105.51 0 top
R32573  10K  [0201]  222.86,106.12 0 top
R32574  10K  [0201]  222.86,106.73 0 top
R32575  10K  [0201]  222.86,107.34 0 top
R32576  10K  [0201]  222.86,107.95 0 top
R32577  10K  [0201]  222.86,108.56 0 top
R32578  10K  [0201]  222.86,109.17 0 top
R32579  10K  [0201]  222.86,109.78 0 top
R32580  10K  [0201]  222.86,110.39 0 top
R32581  10K  [0201]  222.86,111 0 top
R32582  10K  [0201]  222.86,111.61 0 top
R32583  10K  [0201]  222.86,112.22 0 top
R32584  10K  [0201]  222.86,112.83 0 top
R32585  10K  [0201]  222.86,113.44 0 top
R32586  10K  [0201]  222.86,114.05 0 top
R32587  10K  [0201]  222.86,114.66 0 top
R32588  10K  [0201]  222.86,115.27 0 top
R32589  10K  [0201]  222.86,115.87 0 top
R32590  10K  [0201]  222.86,116.48 0 top
R32591  10K  [0201]  222.86,117.09 0 top
R32592  10K  [0201]  222.86,117.7 0 top
R32593  10K  [0201]  222.86,118.31 0 top
R32594  10K  [0201]  222.86,118.92 0 top
R32595  10K  [0201]  222.86,119.53 0 top
R32596  10K  [0201]  222.86,120.14 0 top
R32597  10K  [0201]  222.86,120.75 0 top
R32598  10K  [0201]  222.86,121.36 0 top
R32599  10K  [0201]  222.86,121.97 0 top
R32600  10K  [0201]  222.86,122.58 0 top
R32601  10K  [0201]  224.08,1.27 0 top
R32602  10K  [0201]  224.08,1.88 0 top
R32603  10K  [0201]  224.08,2.49 0 top
R32604  10K  [0201]  224.08,3.1 0 top
R32605  10K  [0201]  224.08,3.71 0 top
R32606  10K  [0201]  224.08,4.32 0 top
R32607  10K  [0201]  224.08,4.93 0 top
R32608  10K  [0201]  224.08,5.54 0 top
R32609  10K  [0201]  224.08,6.15 0 top
R32610  10K  [0201]  224.08,6.76 0 top
R32611  10K  [0201]  224.08,7.37 0 top
R32612  10K  [0201]  224.08,7.98 0 top
R32613  10K  [0201]  224.08,8.59 0 top
R32614  10K  [0201]  224.08,9.19 0 top
R32615  10K  [0201]  224.08,9.8 0 top
R32616  10K  [0201]  224.08,10.41 0 top
R32617  10K  [0201]  224.08,11.02 0 top
R32618  10K  [0201]  224.08,11.63 0 top
R32619  10K  [0201]  224.08,12.24 0 top
R32620  10K  [0201]  224.08,12.85 0 top
R32621  10K  [0201]  224.08,13.46 0 top
R32622  10K  [0201]  224.08,14.07 0 top
R32623  10K  [0201]  224.08,14.68 0 top
R32624  10K  [0201]  224.08,15.29 0 top
R32625  10K  [0201]  224.08,15.9 0 top
R32626  10K  [0201]  224.08,16.51 0 top
R32627  10K  [0201]  224.08,17.12 0 top
R32628  10K  [0201]  224.08,17.73 0 top
R32629  10K  [0201]  224.08,18.34 0 top
R32630  10K  [0201]  224.08,18.95 0 top
R32631  10K  [0201]  224.08,19.56 0 top
R32632  10K  [0201]  224.08,20.17 0 top
R32633  10K  [0201]  224.08,20.78 0 top
R32634  10K  [0201]  224.08,21.39 0 top
R32635  10K  [0201]  224.08,22 0 top
R32636  10K  [0201]  224.08,22.61 0 top
R32637  10K  [0201]  224.08,23.22 0 top
R32638  10K  [0201]  224.08,23.83 0 top
R32639  10K  [0201]  224.08,24.43 0 top
R32640  10K  [0201]  224.08,25.04 0 top
R32641  10K  [0201]  224.08,25.65 0 top
R32642  10K  [0201]  224.08,26.26 0 top
R32643  10K  [0201]  224.08,26.87 0 top
R32644  10K  [0201]  224.08,27.48 0 top
R32645  10K  [0201]  224.08,28.09 0 top
R32646  10K  [0201]  224.08,28.7 0 top
R32647  10K  [0201]  224.08,29.31 0 top
R32648  10K  [0201]  224.08,29.92 0 top
R32649  10K  [0201]  224.08,30.53 0 top
R32650  10K  [0201]  224.08,31.14 0 top
R32651  10K  [0201]  224.08,31.75 0 top
R32652  10K  [0201]  224.08,32.36 0 top
R32653  10K  [0201]  224.08,32.97 0 top
R32654  10K  [0201]  224.08,33.58 0 top
R32655  10K  [0201]  224.08,34.19 0 top
R32656  10K  [0201]  224.08,34.8 0 top
R32657  10K  [0201]  224.08,35.41 0 top
R32658  10K  [0201]  224.08,36.02 0 top
R32659  10K  [0201]  224.08,36.63 0 top
R32660  10K  [0201]  224.08,37.24 0 top
R32661  10K  [0201]  224.08,37.85 0 top
R32662  10K  [0201]  224.08,38.46 0 top
R32663  10K  [0201]  224.08,39.07 0 top
R32664  10K  [0201]  224.08,39.67 0 top
R32665  10K  [0201]  224.08,40.28 0 top
R32666  10K  [0201]  224.08,40.89 0 top
R32667  10K  [0201]  224.08,41.5 0 top
R32668  10K  [0201]  224.08,42.11 0 top
R32669  10K  [0201]  224.08,42.72 0 top
R32670  10K  [0201]  224.08,43.33 0 top
R32671  10K  [0201]  224.08,43.94 0 top
R32672  10K  [0201]  224.08,44.55 0 top
R32673  10K  [0201]  224.08,45.16 0 top
R32674  10K  [0201]  224.08,45.77 0 top
R32675  10K  [0201]  224.08,46.38 0 top
R32676  10K  [0201]  224.08,46.99 0 top
R32677  10K  [0201]  224.08,47.6 0 top
R32678  10K  [0201]  224.08,48.21 0 top
R32679  10K  [0201]  224.08,48.82 0 top
R32680  10K  [0201]  224.08,49.43 0 top
R32681  10K  [0201]  224.08,50.04 0 top
R32682  10K  [0201]  224.08,50.65 0 top
R32683  10K  [0201]  224.08,51.26 0 top
R32684  10K  [0201]  224.08,51.87 0 top
R32685  10K  [0201]  224.08,52.48 0 top
R32686  10K  [0201]  224.08,53.09 0 top
R32687  10K  [0201]  224.08,53.7 0 top
R32688  10K  [0201]  224.08,54.31 0 top
R32689  10K  [0201]  224.08,54.91 0 top
R32690  10K  [0201]  224.08,55.52 0 top
R32691  10K  [0201]  224.08,56.13 0 top
R32692  10K  [0201]  224.08,56.74 0 top
R32693  10K  [0201]  224.08,57.35 0 top
R32694  10K  [0201]  224.08,57.96 0 top
R32695  10K  [0201]  224.08,58.57 0 top
R32696  10K  [0201]  224.08,59.18 0 top
R32697  10K  [0201]  224.08,59.79 0 top
R32698  10K  [0201]  224.08,60.4 0 top
R32699  10K  [0201]  224.08,61.01 0 top
R32700  10K  [0201]  224.08,61.62 0 top
R32701  10K  [0201]  224.08,62.23 0 top
R32702  10K  [0201]  224.08,62.84 0 top
R32703  10K  [0201]  224.08,63.45 0 top
R32704  10K  [0201]  224.08,64.06 0 top
R32705  10K  [0201]  224.08,64.67 0 top
R32706  10K  [0201]  224.08,65.28 0 top
R32707  10K  [0201]  224.08,65.89 0 top
R32708  10K  [0201]  224.08,66.5 0 top
R32709  10K  [0201]  224.08,67.11 0 top
R32710  10K  [0201]  224.08,67.72 0 top
R32711  10K  [0201]  224.08,68.33 0 top
R32712  10K  [0201]  224.08,68.94 0 top
R32713  10K  [0201]  224.08,69.55 0 top
R32714  10K  [0201]  224.08,70.15 0 top
R32715  10K  [0201]  224.08,70.76 0 top
R32716  10K  [0201]  224.08,71.37 0 top
R32717  10K  [0201]  224.08,71.98 0 top
R32718  10K  [0201]  224.08,72.59 0 top
R32719  10K  [0201]  224.08,73.2 0 top
R32720  10K  [0201]  224.08,73.81 0 top
R32721  10K  [0201]  224.08,74.42 0 top
R32722  10K  [0201]  224.08,75.03 0 top
R32723  10K  [0201]  224.08,75.64 0 top
R32724  10K  [0201]  224.08,76.25 0 top
R32725  10K  [0201]  224.08,76.86 0 top
R32726  10K  [0201]  224.08,77.47 0 top
R32727  10K  [0201]  224.08,78.08 0 top
R32728  10K  [0201]  224.08,78.69 0 top
R32729  10K  [0201]  224.08,79.3 0 top
R32730  10K  [0201]  224.08,79.91 0 top
R32731  10K  [0201]  224.08,80.52 0 top
R32732  10K  [0201]  224.08,81.13 0 top
R32733  10K  [0201]  224.08,81.74 0 top
R32734  10K  [0201]  224.08,82.35 0 top
R32735  10K  [0201]  224.08,82.96 0 top
R32736  10K  [0201]  224.08,83.57 0 top
R32737  10K  [0201]  224.08,84.18 0 top
R32738  10K  [0201]  224.08,84.79 0 top
R32739  10K  [0201]  224.08,85.39 0 top
R32740  10K  [0201]  224.08,86 0 top
R32741  10K  [0201]  224.08,86.61 0 top
R32742  10K  [0201]  224.08,87.22 0 top
R32743  10K  [0201]  224.08,87.83 0 top
R32744  10K  [0201]  224.08,88.44 0 top
R32745  10K  [0201]  224.08,89.05 0 top
R32746  10K  [0201]  224.08,89.66 0 top
R32747  10K  [0201]  224.08,90.27 0 top
R32748  10K  [0201]  224.08,90.88 0 top
R32749  10K  [0201]  224.08,91.49 0 top
R32750  10K  [0201]  224.08,92.1 0 top
R32751  10K  [0201]  224.08,92.71 0 top
R32752  10K  [0201]  224.08,93.32 0 top
R32753  10K  [0201]  224.08,93.93 0 top
R32754  10K  [0201]  224.08,94.54 0 top
R32755  10K  [0201]  224.08,95.15 0 top
R32756  10K  [0201]  224.08,95.76 0 top
R32757  10K  [0201]  224.08,96.37 0 top
R32758  10K  [0201]  224.08,96.98 0 top
R32759  10K  [0201]  224.08,97.59 0 top
R32760  10K  [0201]  224.08,98.2 0 top
R32761  10K  [0201]  224.08,98.81 0 top
R32762  10K  [0201]  224.08,99.42 0 top
R32763  10K  [0201]  224.08,100.03 0 top
R32764  10K  [0201]  224.08,100.63 0 top
R32765  10K  [0201]  224.08,101.24 0 top
R32766  10K  [0201]  224.08,101.85 0 top
R32767  10K  [0201]  224.08,102.46 0 top
R32768  10K  [0201]  224.08,103.07 0 top
R32769  10K  [0201]  224.08,103.68 0 top
R32770  10K  [0201]  224.08,104.29 0 top
R32771  10K  [0201]  224.08,104.9 0 top
R32772  10K  [0201]  224.08,105.51 0 top
R32773  10K  [0201]  224.08,106.12 0 top
R32774  10K  [0201]  224.08,106.73 0 top
R32775  10K  [0201]  224.08,107.34 0 top
R32776  10K  [0201]  224.08,107.95 0 top
R32777  10K  [0201]  224.08,108.56 0 top
R32778  10K  [0201]  224.08,109.17 0 top
R32779  10K  [0201]  224.08,109.78 0 top
R32780  10K  [0201]  224.08,110.39 0 top
R32781  10K  [0201]  224.08,111 0 top
R32782  10K  [0201]  224.08,111.61 0 top
R32783  10K  [0201]  224.08,112.22 0 top
R32784  10K  [0201]  224.08,112.83 0 top
R32785  10K  [0201]  224.08,113.44 0 top
R32786  10K  [0201]  224.08,114.05 0 top
R32787  10K  [0201]  224.08,114.66 0 top
R32788  10K  [0201]  224.08,115.27 0 top
R32789  10K  [0201]  224.08,115.87 0 top
R32790  10K  [0201]  224.08,116.48 0 top
R32791  10K  [0201]  224.08,117.09 0 top
R32792  10K  [0201]  224.08,117.7 0 top
R32793  10K  [0201]  224.08,118.31 0 top
R32794  10K  [0201]  224.08,118.92 0 top
R32795  10K  [0201]  224.08,119.53 0 top
R32796  10K  [0201]  224.08,120.14 0 top
R32797  10K  [0201]  224.08,120.75 0 top
R32798  10K  [0201]  224.08,121.36 0 top
R32799  10K  [0201]  224.08,121.97 0 top
R32800  10K  [0201]  224.08,122.58 0 top
R32801  10K  [0201]  225.3,1.27 0 top
R32802  10K  [0201]  225.3,1.88 0 top
R32803  10K  [0201]  225.3,2.49 0 top
R32804  10K  [0201]  225.3,3.1 0 top
R32805  10K  [0201]  225.3,3.71 0 top
R32806  10K  [0201]  225.3,4.32 0 top
R32807  10K  [0201]  225.3,4.93 0 top
R32808  10K  [0201]  225.3,5.54 0 top
R32809  10K  [0201]  225.3,6.15 0 top
R32810  10K  [0201]  225.3,6.76 0 top
R32811  10K  [0201]  225.3,7.37 0 top
R32812  10K  [0201]  225.3,7.98 0 top
R32813  10K  [0201]  225.3,8.59 0 top
R32814  10K  [0201]  225.3,9.19 0 top
R32815  10K  [0201]  225.3,9.8 0 top
R32816  10K  [0201]  225.3,10.41 0 top
R32817  10K  [0201]  225.3,11.02 0 top
R32818  10K  [0201]  225.3,11.63 0 top
R32819  10K  [0201]  225.3,12.24 0 top
R32820  10K  [0201]  225.3,12.85 0 top
R32821  10K  [0201]  225.3,13.46 0 top
R32822  10K  [0201]  225.3,14.07 0 top
R32823  10K  [0201]  225.3,14.68 0 top
R32824  10K  [0201]  225.3,15.29 0 top
R32825  10K  [0201]  225.3,15.9 0 top
R32826  10K  [0201]  225.3,16.51 0 top
R32827  10K  [0201]  225.3,17.12 0 top
R32828  10K  [0201]  225.3,17.73 0 top
R32829  10K  [0201]  225.3,18.34 0 top
R32830  10K  [0201]  225.3,18.95 0 top
R32831  10K  [0201]  225.3,19.56 0 top
R32832  10K  [0201]  225.3,20.17 0 top
R32833  10K  [0201]  225.3,20.78 0 top
R32834  10K  [0201]  225.3,21.39 0 top
R32835  10K  [0201]  225.3,22 0 top
R32836  10K  [0201]  225.3,22.61 0 top
R32837  10K  [0201]  225.3,23.22 0 top
R32838  10K  [0201]  225.3,23.83 0 top
R32839  10K  [0201]  225.3,24.43 0 top
R32840  10K  [0201]  225.3,25.04 0 top
R32841  10K  [0201]  225.3,25.65 0 top
R32842  10K  [0201]  225.3,26.26 0 top
R32843  10K  [0201]  225.3,26.87 0 top
R32844  10K  [0201]  225.3,27.48 0 top
R32845  10K  [0201]  225.3,28.09 0 top
R32846  10K  [0201]  225.3,28.7 0 top
R32847  10K  [0201]  225.3,29.31 0 top
R32848  10K  [0201]  225.3,29.92 0 top
R32849  10K  [0201]  225.3,30.53 0 top
R32850  10K  [0201]  225.3,31.14 0 top
R32851  10K  [0201]  225.3,31.75 0 top
R32852  10K  [0201]  225.3,32.36 0 top
R32853  10K  [0201]  225.3,32.97 0 top
R32854  10K  [0201]  225.3,33.58 0 top
R32855  10K  [0201]  225.3,34.19 0 top
R32856  10K  [0201]  225.3,34.8 0 top
R32857  10K  [0201]  225.3,35.41 0 top
R32858  10K  [0201]  225.3,36.02 0 top
R32859  10K  [0201]  225.3,36.63 0 top
R32860  10K  [0201]  225.3,37.24 0 top
R32861  10K  [0201]  225.3,37.85 0 top
R32862  10K  [0201]  225.3,38.46 0 top
R32863  10K  [0201]  225.3,39.07 0 top
R32864  10K  [0201]  225.3,39.67 0 top
R32865  10K  [0201]  225.3,40.28 0 top
R32866  10K  [0201]  225.3,40.89 0 top
R32867  10K  [0201]  225.3,41.5 0 top
R32868  10K  [0201]  225.3,42.11 0 top
R32869  10K  [0201]  225.3,42.72 0 top
R32870  10K  [0201]  225.3,43.33 0 top
R32871  10K  [0201]  225.3,43.94 0 top
R32872  10K  [0201]  225.3,44.55 0 top
R32873  10K  [0201]  225.3,45.16 0 top
R32874  10K  [0201]  225.3,45.77 0 top
R32875  10K  [0201]  225.3,46.38 0 top
R32876  10K  [0201]  225.3,46.99 0 top
R32877  10K  [0201]  225.3,47.6 0 top
R32878  10K  [0201]  225.3,48.21 0 top
R32879  10K  [0201]  225.3,48.82 0 top
R32880  10K  [0201]  225.3,49.43 0 top
R32881  10K  [0201]  225.3,50.04 0 top
R32882  10K  [0201]  225.3,50.65 0 top
R32883  10K  [0201]  225.3,51.26 0 top
R32884  10K  [0201]  225.3,51.87 0 top
R32885  10K  [0201]  225.3,52.48 0 top
R32886  10K  [0201]  225.3,53.09 0 top
R32887  10K  [0201]  225.3,53.7 0 top
R32888  10K  [0201]  225.3,54.31 0 top
R32889  10K  [0201]  225.3,54.91 0 top
R32890  10K  [0201]  225.3,55.52 0 top
R32891  10K  [0201]  225.3,56.13 0 top
R32892  10K  [0201]  225.3,56.74 0 top
R32893  10K  [0201]  225.3,57.35 0 top
R32894  10K  [0201]  225.3,57.96 0 top
R32895  10K  [0201]  225.3,58.57 0 top
R32896  10K  [0201]  225.3,59.18 0 top
R32897  10K  [0201]  225.3,59.79 0 top
R32898  10K  [0201]  225.3,60.4 0 top
R32899  10K  [0201]  225.3,61.01 0 top
R32900  10K  [0201]  225.3,61.62 0 top
R32901  10K  [0201]  225.3,62.23 0 top
R32902  10K  [0201]  225.3,62.84 0 top
R32903  10K  [0201]  225.3,63.45 0 top
R32904  10K  [0201]  225.3,64.06 0 top
R32905  10K  [0201]  225.3,64.67 0 top
R32906  10K  [0201]  225.3,65.28 0 top
R32907  10K  [0201]  225.3,65.89 0 top
R32908  10K  [0201]  225.3,66.5 0 top
R32909  10K  [0201]  225.3,67.11 0 top
R32910  10K  [0201]  225.3,67.72 0 top
R32911  10K  [0201]  225.3,68.33 0 top
R32912  10K  [0201]  225.3,68.94 0 top
R32913  10K  [0201]  225.3,69.55 0 top
R32914  10K  [0201]  225.3,70.15 0 top
R32915  10K  [0201]  225.3,70.76 0 top
R32916  10K  [0201]  225.3,71.37 0 top
R32917  10K  [0201]  225.3,71.98 0 top
R32918  10K  [0201]  225.3,72.59 0 top
R32919  10K  [0201]  225.3,73.2 0 top
R32920  10K  [0201]  225.3,73.81 0 top
R32921  10K  [0201]  225.3,74.42 0 top
R32922  10K  [0201]  225.3,75.03 0 top
R32923  10K  [0201]  225.3,75.64 0 top
R32924  10K  [0201]  225.3,76.25 0 top
R32925  10K  [0201]  225.3,76.86 0 top
R32926  10K  [0201]  225.3,77.47 0 top
R32927  10K  [0201]  225.3,78.08 0 top
R32928  10K  [0201]  225.3,78.69 0 top
R32929  10K  [0201]  225.3,79.3 0 top
R32930  10K  [0201]  225.3,79.91 0 top
R32931  10K  [0201]  225.3,80.52 0 top
R32932  10K  [0201]  225.3,81.13 0 top
R32933  10K  [0201]  225.3,81.74 0 top
R32934  10K  [0201]  225.3,82.35 0 top
R32935  10K  [0201]  225.3,82.96 0 top
R32936  10K  [0201]  225.3,83.57 0 top
R32937  10K  [0201]  225.3,84.18 0 top
R32938  10K  [0201]  225.3,84.79 0 top
R32939  10K  [0201]  225.3,85.39 0 top
R32940  10K  [0201]  225.3,86 0 top
R32941  10K  [0201]  225.3,86.61 0 top
R32942  10K  [0201]  225.3,87.22 0 top
R32943  10K  [0201]  225.3,87.83 0 top
R32944  10K  [0201]  225.3,88.44 0 top
R32945  10K  [0201]  225.3,89.05 0 top
R32946  10K  [0201]  225.3,89.66 0 top
R32947  10K  [0201]  225.3,90.27 0 top